# Altium schematic sheet Modules.SchDoc: Screen, LED and IR
size A4; SheetNumber: 6; SheetTotal: 6
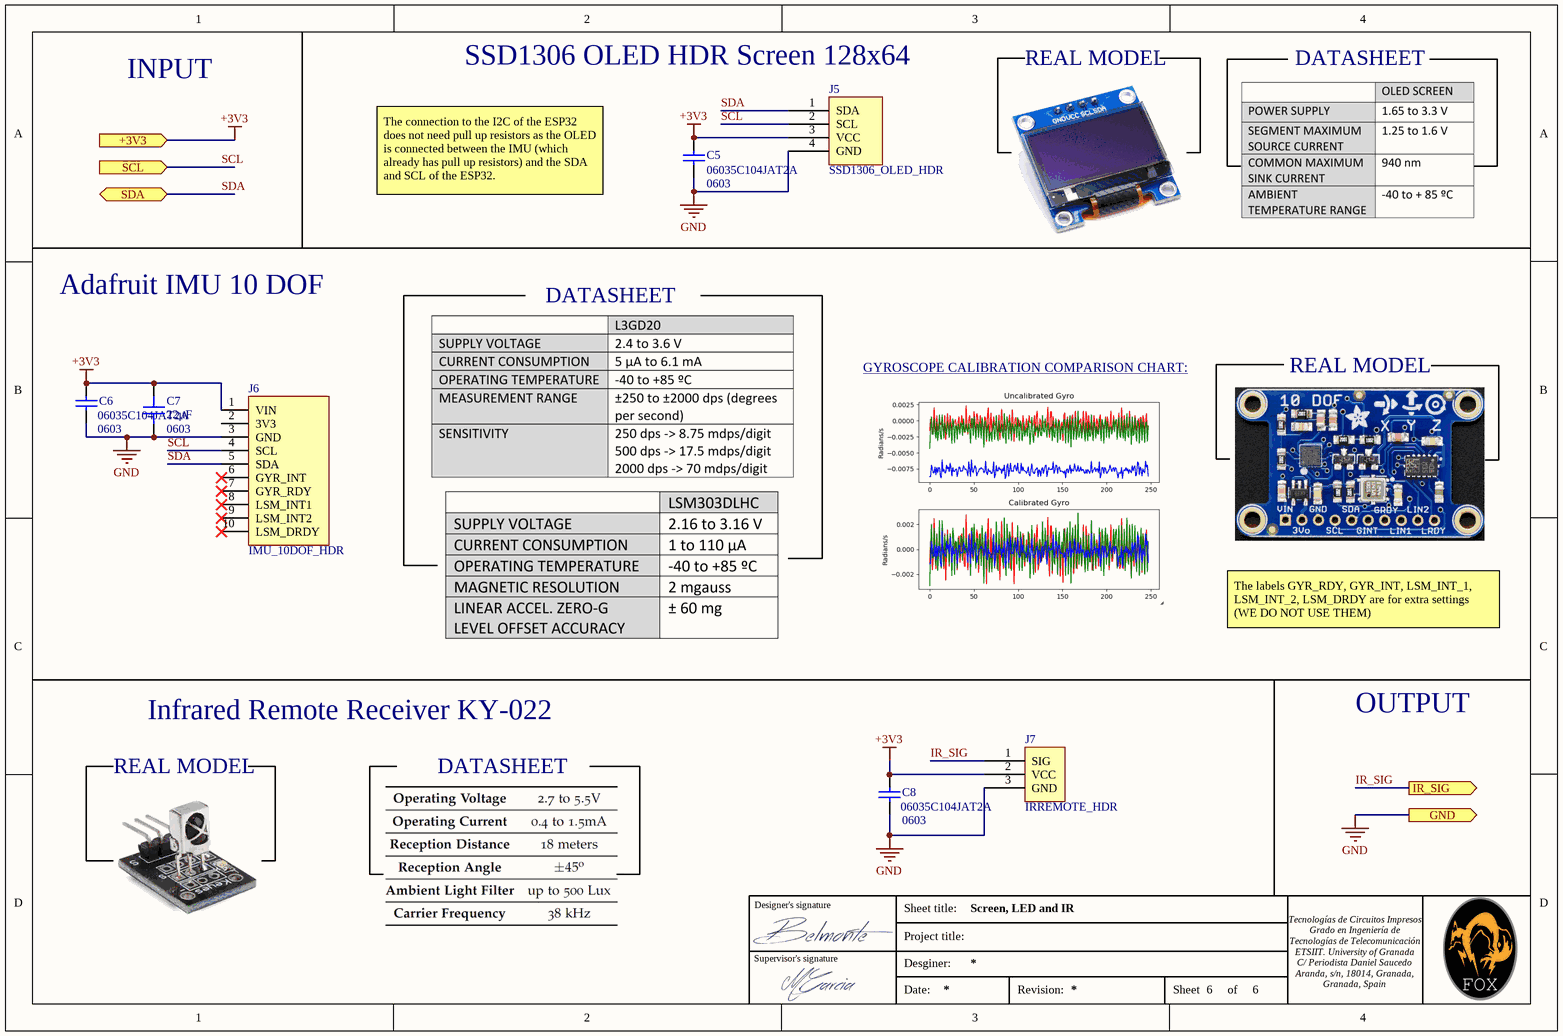
[diagram p0: Modules.SchDoc]

## Parts
C5  06035C104JAT2A  [CAPC1608X90X35NL15T15]
C6  06035C104JAT2A  [CAPC1608X90X35NL15T15]
C7  22µF  [CAP 0603_1608]
C8  06035C104JAT2A  [CAPC1608X90X35NL15T15]
J5  SSD1306_OLED_HDR  [OLED_guarreta]
J6  IMU_10DOF_HDR  [IMU_GUARRETA]
J7  IRREMOTE_HDR  [IRremote_guarreta]

## Ports
+3V3 (in), GND (out), IR_SIG (out), SCL (in), SDA (bidir)

## Nets
+3V3: C5.2 C6.2 C7.2 C8.2 J5.3(VCC) J6.1(VIN) J7.2(VCC) ; port +3V3
GND: C5.1 C6.1 C7.1 C8.1 J5.4(GND) J6.3(GND) J7.3(GND) ; port GND
IR_SIG: J7.1(SIG) ; port IR_SIG
SCL: J5.2(SCL) J6.4(SCL) ; port SCL
SDA: J5.1(SDA) J6.5(SDA) ; port SDA

Not connected (* = marked no-connect by the designer): J6 2(3V3) 6(GYR_INT)* 7(GYR_RDY)* 8(LSM_INT1)* 9(LSM_INT2)* 10(LSM_DRDY)*

## Notes on the sheet
- INPUT
- (near J5) SSD1306 OLED HDR Screen 128x64
- REAL MODEL
- DATASHEET
- The connection to the I2C of the ESP32 does not need pull up resistors as the OLED is connected between the IMU (which already has pull up resistors) and the SDA and SCL of the ESP32.
- (near C5) 0603
- Adafruit IMU 10 DOF
- GYROSCOPE CALIBRATION COMPARISON CHART: <The chart comparing the calibrated and uncalibrated gyro has been taken from https://learn.adafruit.com/adafruit-sensorlab-gyroscope-calibration?view=all>
- (near C6) 0603
- (near C7) 0603
- The labels GYR_RDY, GYR_INT, LSM_INT_1, LSM_INT_2, LSM_DRDY are for extra settings (WE DO NOT USE THEM)
- OUTPUT
- Infrared Remote Receiver KY-022
- (near C8) 0603
- Designer's signature
- Sheet title:
- Supervisor's signature
- Project title:
- Desginer:
- Tecnologías de Circuitos Impresos
  Grado en Ingeniería de Tecnologías de Telecomunicación
  ETSIIT. University of Granada
  C/ Periodista Daniel Saucedo Aranda, s/n, 18014, Granada, Granada, Spain
- Date:
- Revision:
- Sheet
- of

## Library data of the parts
C5 C6 C8 = CMP-2006-02049-1: Manufacturer: AVX Interconnect / Elco; Part Number: 06035C104JAT2A
C7 = C1608X5R0G226M080AA: CAP CER 22UF 4V X5R 0603; Manufacturer: TDK Corporation; Tolerance: ±20%; Part Number: C1608X5R0G226M080AA; Value: 22µF; Applications: General Purpose; Capacitance: 22µF; ComponentLink1Description: Datasheet; ComponentLink1URL: https://product.tdk.com/info/en/catalog/datasheets/mlcc_commercial_general_en.pdf?ref_disty=digikey; ComponentLink2Description: DigiKey Link; ComponentLink2URL: http://digikey.com/product-detail/en/tdk-corporation/C1608X5R0G226M080AA/445-8030-1-ND/2792156; Device Package: 0603 (1608 Metric); LastUpdated: 09/02/2020 01:03:35; Lifecycle Status: Active; Minimum Order: 1; Mounting Type: Surface Mount, MLCC; Operating Temperature: -55°C ~ 85°C; Package / Case: 0603 (1608 Metric); Packaging: TapeAndReel; PartId: 2599; Part Status: Active; Price: 0.09; Series: C; Size / Dimension: 0.063" L x 0.031" W (1.60mm x 0.80mm); Supplier 1: DigiKey; Supplier Part Number 1: 445-8030-1-ND; Temperature Coefficient: X5R; Thickness (Max): 0.039" (1.00mm); Voltage - Rated: 4V
J5 = SSD_GUARRETA: CONN HDR 4POS 0.1 TIN PCB; Manufacturer: Sullins; Manufacturer Part Number: PPTC041LFBN-RC; Number of Positions: 4; Connector Type: Header,Socket; Pitch: 0.1inch; Supplier 1: Digi-Key; RoHS: Yes; Category: Connectors; Stock 1: 41925; Pricing 1: 1=0,45000, 10=0,42400, 100=0,32500, 500=0,28260, 1000=0,23315, 5000=0,20489, 10000=0,20410 (USD); Mount: Through Hole; Contact Plating: Tin; Contact Material: Bronze; Color: Black; Housing Material: Plastic; Termination: Solder; Package Quantity: 1000; Number of Rows: 1; Packaging: Bulk; Length: 10.7mm; Width: 2.5mm; Height: 8.5mm; Lead Free: Lead Free; ComponentLink1URL: https://media.digikey.com/pdf/Data%20Sheets/Sullins%20PDFs/Female_Headers.100_DS.pdf?src-supplier=Digi-Key; ComponentLink1Description: https://media.digikey.com/pdf/Data%20Sheets/Sullins%20PDFs/Female_Headers.100_DS.pdf?src-supplier=Digi-Key; ComponentLink2URL: http://www.sullinscorp.com/catalogs/78_Page80-81_HEADER_.100_2.54mm_FEMALE.pdf?src-supplier=Future+Electronics; ComponentLink2Description: http://www.sullinscorp.com/catalogs/78_Page80-81_HEADER_.100_2.54mm_FEMALE.pdf?src-supplier=Future+Electronics; Supplier Part Number 1: S7002-ND
J6 = IMU_GUARRETA: CONN HDR 10POS 0.1 TIN PCB; Manufacturer: Sullins; Manufacturer Part Number: PPTC101LFBN-RC; Number of Positions: 10; Connector Type: Header; Pitch: 0.1inch; Supplier 1: Digi-Key; RoHS: Yes; Category: Connectors; Stock 1: 12464; Pricing 1: 1=0,65000, 10=0,57400, 100=0,49500, 500=0,40500, 1000=0,36000, 5000=0,32500 (USD); Mount: Through Hole; Color: Black; Contact Plating: Tin; Contact Material: Bronze; Housing Material: Plastic; Package Quantity: 1000; Number of Rows: 1; Packaging: Bulk; Termination: Solder; Contact Type: Female Socket; Length: 25.9mm; Width: 2.5mm; Height: 8.5mm; Lead Free: Lead Free; RoHS Compliant: Yes; ComponentLink1URL: https://media.digikey.com/pdf/Data%20Sheets/Sullins%20PDFs/Female_Headers.100_DS.pdf?src-supplier=Digi-Key; ComponentLink1Description: https://media.digikey.com/pdf/Data%20Sheets/Sullins%20PDFs/Female_Headers.100_DS.pdf?src-supplier=Digi-Key; Supplier Part Number 1: S7008-ND
J7 = IRREMOTE_GUARRETA: CONN HDR 3POS 0.1 GOLD PCB; Manufacturer: Sullins; Manufacturer Part Number: PPPC031LFBN-RC; Number of Positions: 3; Connector Type: Header; Pitch: 0.1inch; Supplier 1: Digi-Key; RoHS: Yes; Category: Connectors; Stock 1: 36124; Pricing 1: 1=0,37000, 10=0,35100, 100=0,26910, 500=0,23400, 1000=0,19305, 5000=0,16965, 10000=0,16900 (USD); Mount: Through Hole; Color: Black; Contact Plating: Gold; Contact Material: Bronze; Housing Material: Plastic; Package Quantity: 1000; Number of Rows: 1; Packaging: Bulk; Termination: Solder; Contact Type: Female Socket; Length: 8.12mm; Width: 2.5mm; Height: 8.5mm; Lead Free: Lead Free; RoHS Compliant: Yes; ComponentLink1URL: https://media.digikey.com/pdf/Data%20Sheets/Sullins%20PDFs/Female_Headers.100_DS.pdf?src-supplier=Digi-Key; ComponentLink1Description: https://media.digikey.com/pdf/Data%20Sheets/Sullins%20PDFs/Female_Headers.100_DS.pdf?src-supplier=Digi-Key; ComponentLink2URL: http://www.sullinscorp.com/catalogs/78_Page80-81_HEADER_.100_2.54mm_FEMALE.pdf?src-supplier=Future+Electronics; ComponentLink2Description: http://www.sullinscorp.com/catalogs/78_Page80-81_HEADER_.100_2.54mm_FEMALE.pdf?src-supplier=Future+Electronics; Supplier Part Number 1: S7036-ND